# EasyEDA Pro project RCKid3.eprj, board RCKid (continued)
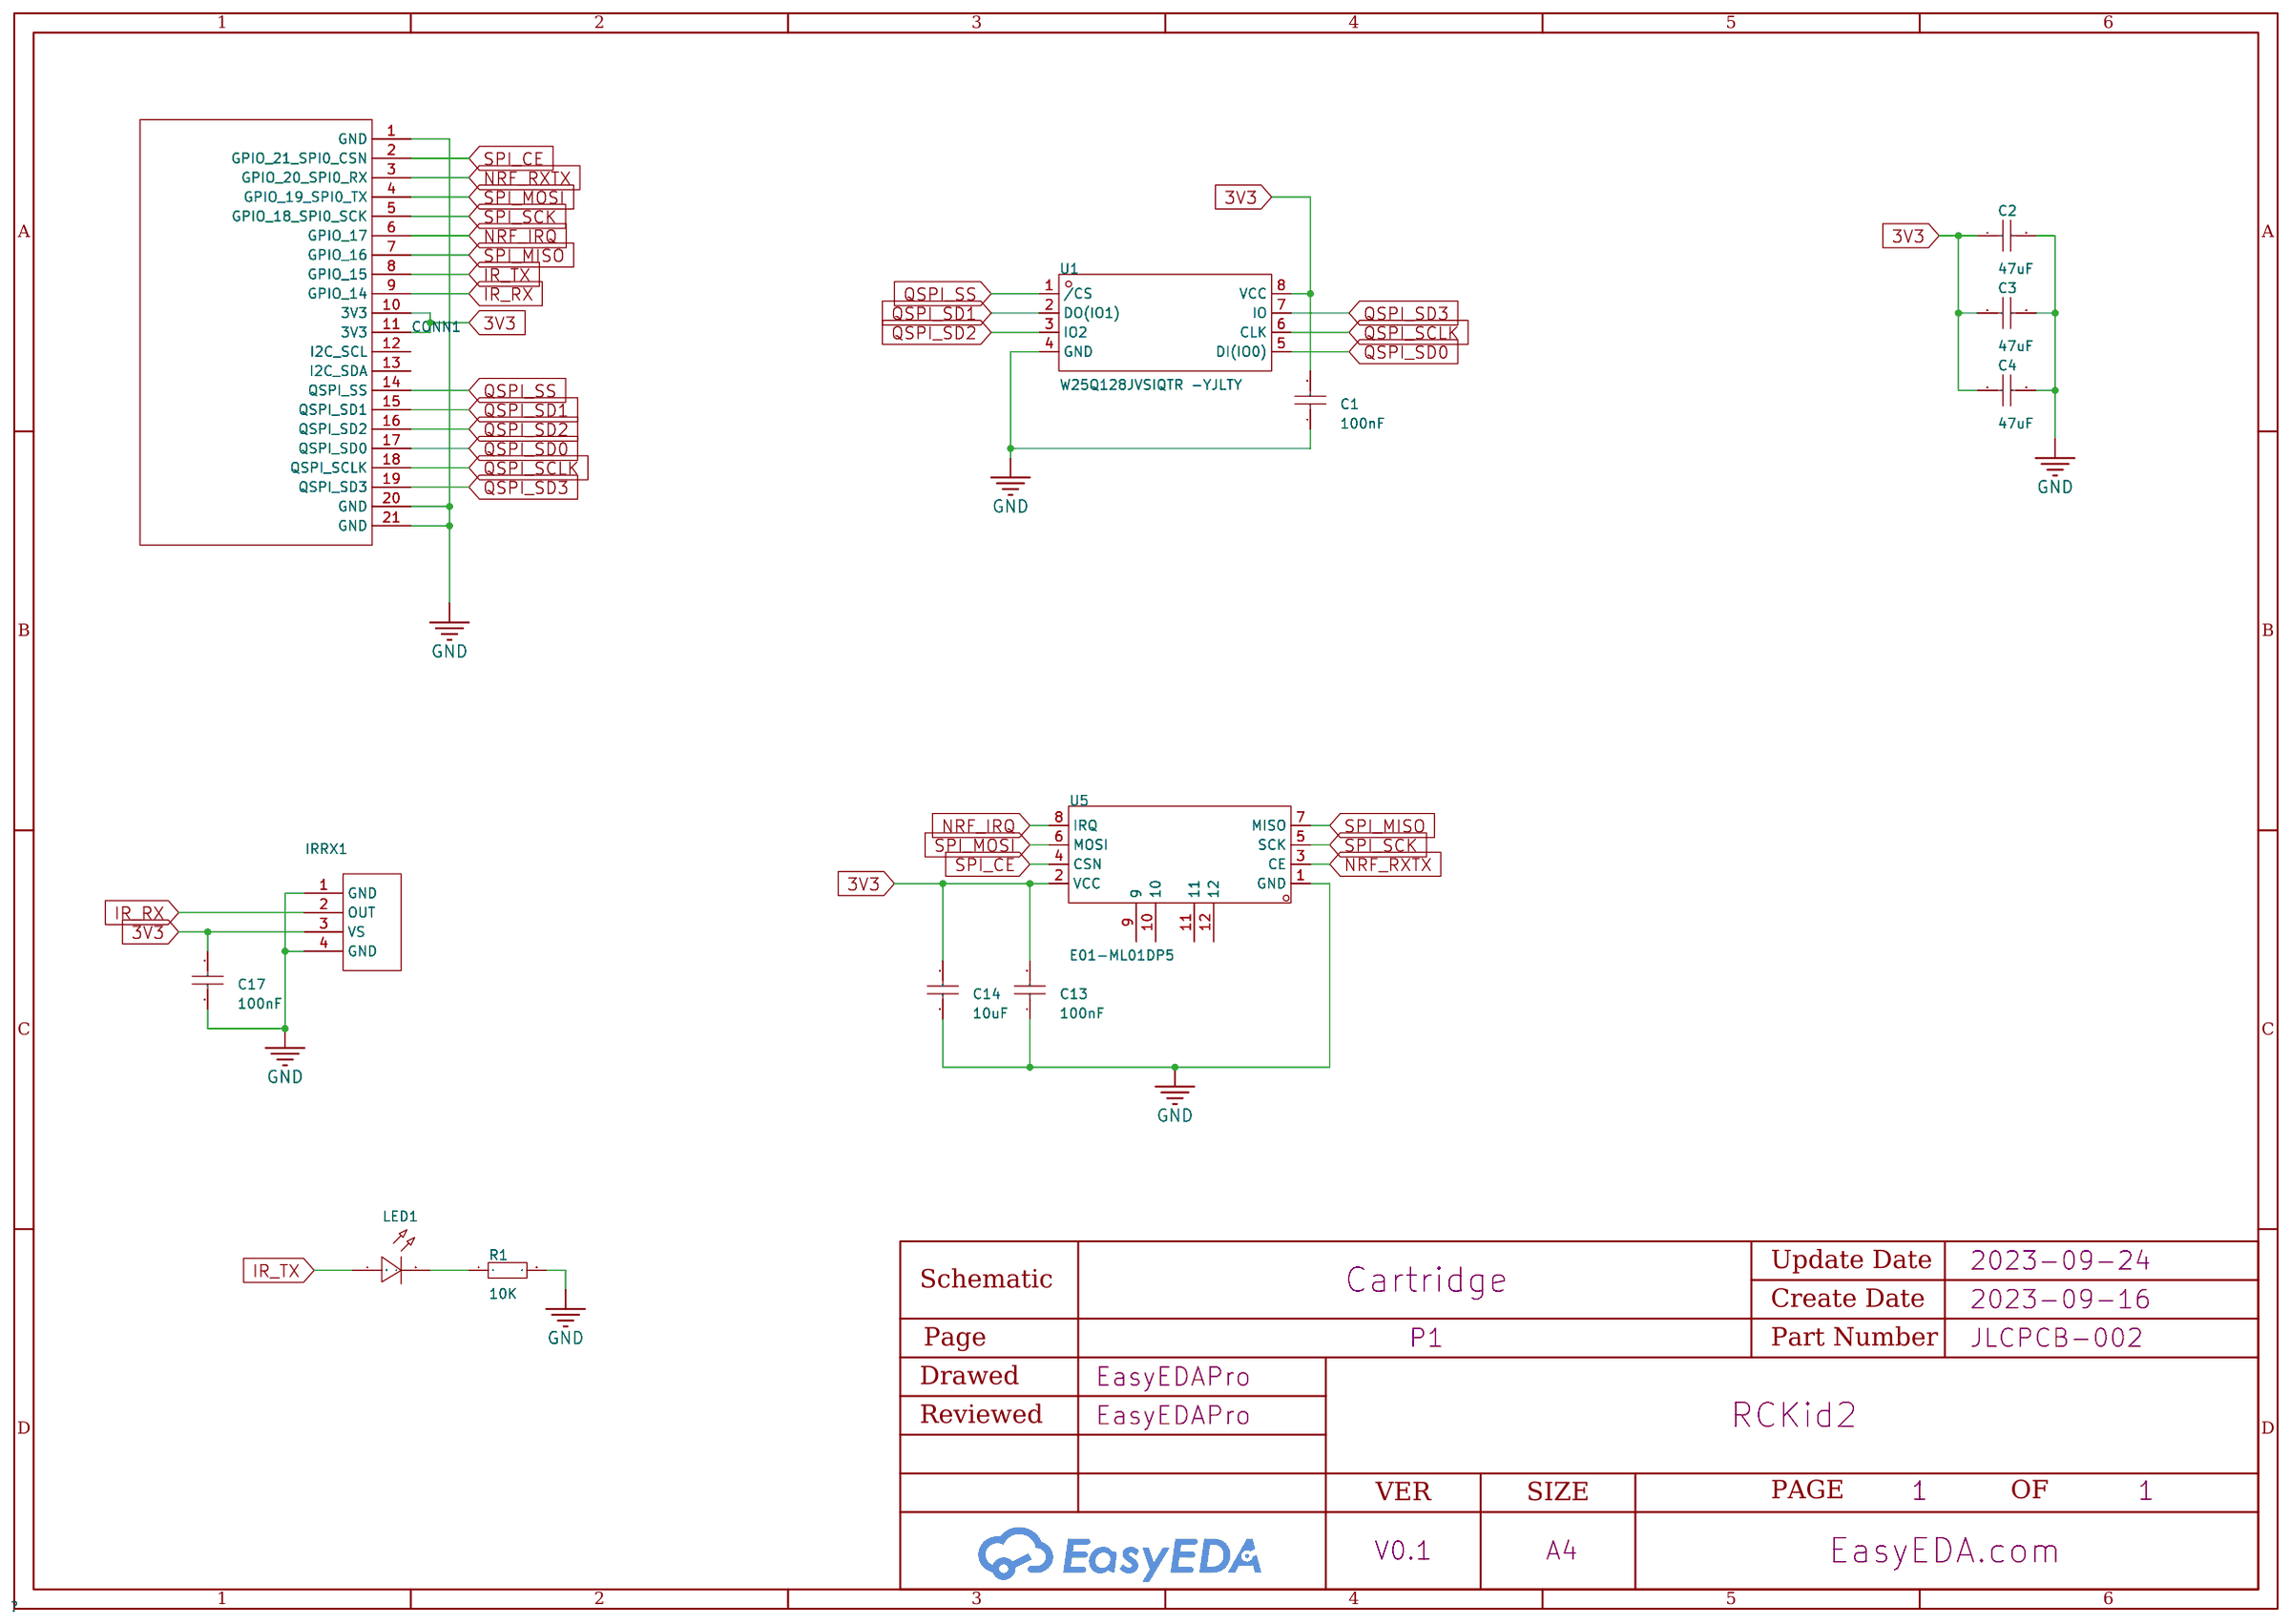
[diagram p0: NRF24L01P]
## Routing (per net, layer and track width the routed paths; a pad name or vN(x,y) marks a point on that pad's centre or on a via; arc(x,y) is an arc through that point) (continued)
MIC_N: length 6.7
  Top Layer w0.15: AUDIO.13 55.05,34.24 53.9,33.09 C206.1
MIC_P: length 4.5
  Top Layer w0.15: 55.7,30.44 55.9,30.44 55.9,33.19 56.45,33.74 AUDIO.14
PWM_BACKLIGHT: length 37.9
  Top Layer w0.15: v1(31.9,51.79) 32.25,51.44 32.25,50.22
  Top Layer w0.2: v1(45.5,69.89) 52.3,69.89 53.4,70.99 R92.2
  Bottom Layer w0.15: v1(45.5,69.89) 40.4,64.79 40.4,60.09 39.8,59.49 34.5,59.49 31.9,56.89 v1(31.9,51.79)
PWM_RUMBLER: length 3.8
  Top Layer w0.15: AVR.2 32.25,43.87 33.3,42.82
PWR_INT: length 48.1
  Top Layer w0.15: 31.7,43.49 29.2,43.49 28.1,42.39 26.8,42.39 v1(26.4,41.99) ; v1(19.7,23.69) v1(18.3,25.09) ; v1(12.7,19.69) 12.7,20.29 12.61,20.29 PWR.7 ; 32.2,42.89 32.2,42.99 31.75,43.44 AVR.1
  Bottom Layer w0.15: v1(19.7,23.69) 20.7,22.69 20.7,18.69 R127.2 R126.1 ; v1(26.4,41.99) 26.4,33.19 v1(18.3,25.09) 13.9,20.69 13.9,20.09 13.5,19.69 v1(12.7,19.69)
QSPI_SCLK: length 16.3
  Top Layer w0.15: CARTRIDGE.19 13.8,61.01 13.8,61.89 arc(13.89,62.1) 14.1,62.19 14.3,62.19 arc(14.6,62.49) 14.3,62.79 14.1,62.79 arc(13.8,63.09) 14.1,63.39 14.3,63.39 arc(14.6,63.69) 14.3,63.99 14.1,63.99 arc(13.89,64.08) 13.8,64.29 13.8,64.79 15.4,66.39 15.4,70.09 14.4,71.09 RP2350B.71
QSPI_SD0: length 16.3
  Top Layer w0.15: CARTRIDGE.18 16.32,61.89 arc(16.41,62.1) 16.62,62.19 16.7,62.19 arc(17,62.49) 16.7,62.79 16.62,62.79 arc(16.32,63.09) 16.62,63.39 16.7,63.39 arc(17,63.69) 16.7,63.99 16.62,63.99 arc(16.32,64.29) 16.62,64.59 16.7,64.59 arc(17,64.89) 16.7,65.19 16.62,65.19 arc(16.41,65.28) 16.32,65.49 16.32,69.87 14.8,71.39 RP2350B.72
QSPI_SD1: length 16.4
  Top Layer w0.15: CARTRIDGE.16 21.4,61.89 arc(21.49,62.1) 21.7,62.19 21.8,62.19 arc(22.1,62.49) 21.8,62.79 21.7,62.79 arc(21.49,62.88) 21.4,63.09 21.4,66.19 15.6,71.99 RP2350B.74
QSPI_SD2: length 16.5
  Top Layer w0.15: RP2350B.73 15.2,71.69 18.86,68.03 18.86,64.29 arc(18.95,64.08) 19.16,63.99 19.3,63.99 arc(19.6,63.69) 19.3,63.39 19.16,63.39 arc(18.86,63.09) 19.16,62.79 19.3,62.79 arc(19.6,62.49) 19.3,62.19 19.16,62.19 arc(18.95,62.1) 18.86,61.89 CARTRIDGE.17
QSPI_SD3: length 16.3
  Top Layer w0.15: RP2350B.70 14,70.79 14.9,69.89 14.9,66.99 11.2,63.29 11.2,62.99 arc(11.29,62.78) 11.5,62.69 11.8,62.69 arc(12.1,62.39) 11.8,62.09 11.5,62.09 arc(11.29,62) 11.2,61.79 11.2,61.03 CARTRIDGE.20
QSPI_SS: length 33.9
  Top Layer w0.15: v1(27.5,54.69) 27.5,51.99 28.3,51.19 31.4,51.19 31.75,50.84 31.75,50.22 ; 24,59.32 23.94,59.38 CARTRIDGE.15 23.94,64.35 16,72.29 RP2350B.75
  Bottom Layer w0.15: CARTRIDGE.15 27.5,57.43 v1(27.5,54.69)
RADIO_INT: length 82.1
  Top Layer w0.15: RADIO.18 54.74,18.35 v1(54.2,18.89) ; v1(52.3,28.59) 52.3,39.69 50.3,41.69 50.3,53.19 47.4,56.09 34.4,56.09 34,56.49 31.2,56.49 28,59.69 28,63.49 22.5,68.99 22.5,71.49 19.11,74.88 RP2350B.1
  Bottom Layer w0.15: v1(52.3,28.59) 52.3,22.09 TP4.1 54.2,19.89 v1(54.2,18.89)
RADIO_L: length 3.4
  Top Layer w0.15: AUDIO.15 56.75,33.24 56.5,32.99 56.5,31.49 56.7,31.29 56.7,30.44
RADIO_R: length 2.5
  Top Layer w0.15: AUDIO.16 57.17,31.62 57.7,31.09 57.7,30.44
RADIO_RESET: length 90.4
  Top Layer w0.15: v1(52.2,20.79) 52.2,16.49 v1(53.6,15.09) ; v1(58.3,15.59) 58.02,15.87 RADIO.5 ; RP2350B.79 17.6,73.44 17.75,73.29 18.7,73.29 21.6,70.39 21.6,69.04 27.6,63.04 27.6,59.19 30.9,55.89 33.7,55.89 34.1,55.49 47.1,55.49 49.7,52.89 49.7,41.39 51.7,39.39 v1(51.7,29.49)
  Bottom Layer w0.15: v1(58.3,15.59) 58.3,15.19 57.8,14.69 54,14.69 v1(53.6,15.09) ; v1(52.2,20.79) 51.7,21.29 v1(51.7,29.49)
RGB: length 5.1
  Top Layer w0.15: U33.3 37.45,44.44 36.3,45.59 36.3,46.59 35.95,46.94 35.02,46.94
RPI_SWCLK: length 26.7
  Top Layer w0.15: RP2350B.33 13.2,85.49 v1(12.7,85.99)
  Bottom Layer w0.15: 1.4,71.3 3,72.9 3,84.89 4.1,85.99 v1(12.7,85.99)
RPI_SWD: length 25.4
  Top Layer w0.15: RP2350B.34 12.8,84.89 12,85.69 v1(12,86.89)
  Bottom Layer w0.15: v1(12,86.89) 4.1,86.89 1.4,84.19 1.4,73.84
SD_CSN: length 80.6
  Top Layer w0.15: RP2350B.56 8.4,76.79 7.5,75.89 2.6,75.89 1,77.49 1,89.79 1.2,89.99 1.2,96.59 5.6,100.99 34.3,100.99 34.6,100.69 46.7,100.69 48,99.39 L15.2
SD_RX: length 78.2
  Top Layer w0.15: L15.3 47.6,98.89 46.5,99.99 34.4,99.99 33.8,100.59 6,100.59 1.8,96.39 1.8,89.79 1.4,89.39 1.4,77.79 2.9,76.29 7.3,76.29 8.2,77.19 RP2350B.55
SD_SCK: length 73.4
  Top Layer w0.15: RP2350B.53 7.87,77.99 6.97,77.09 3.5,77.09 2.2,78.39 2.2,88.59 3,89.39 3,95.99 6.8,99.79 32.8,99.79 34,98.59 46.1,98.59 46.8,97.89 L15.5
SD_TX: length 75.8
  Top Layer w0.15: RP2350B.54 8.03,77.59 7.13,76.69 3.2,76.69 1.8,78.09 1.8,88.99 2.4,89.59 2.4,96.19 6.4,100.19 33.3,100.19 34.2,99.29 46.3,99.29 47.2,98.39 L15.4
SDIO_1: length 71
  Top Layer w0.15: L15.6 46.4,97.39 45.9,97.89 33.8,97.89 32.3,99.39 7.2,99.39 3.6,95.79 3.6,89.19 2.6,88.19 2.6,78.69 3.8,77.49 6.8,77.49 7.7,78.39 RP2350B.52
SDIO_2: length 83
  Top Layer w0.15: RP2350B.57 8.57,76.39 7.67,75.49 2.3,75.49 0.6,77.19 0.6,96.79 5.2,101.39 46.9,101.39 48.4,99.89 L15.1
SPEAKER_EN: length 12.2
  Top Layer w0.15: v1(62.1,37.09) 62.03,37.02 AUDIO.32 ; 63.7,27.19 v1(64.3,27.79)
  Bottom Layer w0.15: v1(62.1,37.09) 62.5,37.09 64,35.59 64,28.69 64.3,28.39 v1(64.3,27.79)
SPEAKER_N: length 2.9
  Top Layer w0.15: AUDIO.22 60.35,31.34 60.7,30.99 61.3,30.99 61.7,30.59 R105.1
SPEAKER_P: length 3.3
  Top Layer w0.15: R106.1 62.7,30.49 61.8,31.39 61,31.39 60.85,31.54 AUDIO.23
SPI0_CSN_GPIO_21:
  vias: v1(-25.5,74.59)
SPI0_RX_GPIO_20:
  vias: v1(-23,74.59)
SPI0_SCK_GPIO_18:
  vias: v1(-17.9,74.59)
SPI0_TX_GPIO_19:
  vias: v1(-20.4,74.59)
UPDI: length 37.4
  Top Layer w0.15: 30.92,47.49 AVR.23 24.85,47.44 14.1,58.19 v1(12.8,58.19)
  Bottom Layer w0.15: DEBUG.2 1.44,66.25 9.5,58.19 v1(12.8,58.19)
USB_DM: length 72.6
  Top Layer w0.15: USB.A7 12.95,10.24 13.1,10.39 v1(13.1,10.79)
  Top Layer w0.154: USB.B7 11.95,10.64 12.1,10.79 v1(12.1,11.29) 12.1,11.66 11.47,12.29 6.87,12.29 0.89,18.26 0.89,46.62 9.99,55.72 9.99,63.92 12.3,66.22 12.3,66.59 12,66.89 R50.1
  Bottom Layer w0.15: v1(12.1,11.29) 12.6,11.29 v1(13.1,10.79)
USB_DP: length 72.9
  Top Layer w0.154: 12.9,11.29 13.3,11.29 13.6,10.99 13.6,10.59 13.4,10.39 13.4,9.61 USB.B6 ; 12.9,11.29 11.59,12.6 6.99,12.6 1.2,18.39 1.2,46.49 10.3,55.59 10.3,63.79 13.2,66.69 R51.1 ; 12.9,11.29 12.45,10.84 USB.A6
VUSB: length 16.5
  Top Layer w0.25: PWR.1 9.45,17.89 9.35,17.79
  Top Layer w0.5: v1(10.6,11.49) 10.3,11.19 USB.B9A4 ; USB.A9B4 v1(15.1,10.59) v1(15.1,11.19)
  Bottom Layer w0.5: v1(15.1,10.59) v1(15.1,11.19) v1(14.6,11.69) v1(14.1,12.19) v1(13,12.19) 11.3,12.19 v1(10.6,11.49) ; v1(12.5,15.19) D16.2 12.47,14.29 v1(11.6,14.29) R52.2
  Bottom Layer w0.7: D16.2 13.43,14.32 13.65,14.54 Q8.1
  vias: v1(13.4,14.29)
XIN: length 10.3
  Top Layer w0.2: RP2350B.30 14.4,86.67 14.6,86.87 14.6,88.74 C153.1 14.5,90.35 14.5,91.99 15.35,92.84 U39.1
XOUT: length 3.4
  Top Layer w0.2: RP2350B.31 14,87.26
$1N1000: length 4.5
  Top Layer w0.5: 5V.4 31.1,25.69 29,25.69 28.3,24.99 C83.1
$1N1001: length 4.5
  Top Layer w0.5: C83.2 28.3,22.99 29,22.29 31.1,22.29 5V.6
$1N63321: length 0.5
  Top Layer w0.15: PWR.2 PWR.3
$1N63464: length 6.5
  Top Layer w0.25: PWR.22 8.78,21.29 4.45,21.29 3.64,20.49 3.53,20.38 3.53,19.49
$1N63621: length 4.3
  Top Layer w0.15: 14.5,18.49 13.9,18.49 13.6,18.79 13.6,20.99 13.3,21.29 PWR.9
$1N63731: length 3.5
  Top Layer w0.25: C215.2 6.95,20.54 7.55,20.54 7.8,20.79 8.78,20.79 PWR.23
  Top Layer w0.5: C215.2 6.8,19.09
$1N64929: length 5.2
  Top Layer w0.25: 3.6,21.95 3.75,21.79 PWR.21
$1N65109: length 5.6
  Top Layer w0.15: PWR.8 13.1,20.79 13.2,20.69 13.2,17.29 13.6,16.89 14.33,16.89 14.5,16.72
$1N65541: length 13.5
  Top Layer w0.15: R113.1 2.63,18.59 v1(4.4,18.59) ; 12.6,22.29 v1(13.6,22.29)
  Bottom Layer w0.15: v1(13.6,22.29) 12.8,21.49 7.4,21.49 4.5,18.59 v1(4.4,18.59)
$1N65681: length 2
  Top Layer w0.15: PWR.10 13.4,21.79 13.6,21.59 14.35,21.59 14.5,21.74 14.5,21.74
$1N67269: length 1.9
  Top Layer w0.27: 27.2,32.59 27.2,33.79 26.7,34.29
$1N67295: length 4.2
  Top Layer w0.15: 27.9,29.59 26.8,29.59 ; 27.9,28.49 27.9,29.49 28,29.59 28,30.29 27.7,30.59 27.7,31.39
$1N67403: length 4.3
  Top Layer w0.15: 38,36.39 38,35.29 ; 38,36.39 38,37.19 37.7,37.49 37.7,38.29 ; 38,36.39 36.8,36.39
$1N67445: length 1.7
  Top Layer w0.27: 37.2,39.39 37.2,40.49 36.8,40.89
$1N73932: length 22.3
  Bottom Layer w0.7: Q8.2 13.55,16.44 13.33,16.66 D16.1 9.27,16.66 8.7,16.09 5.5,16.09 3.5,18.09 3.5,27.96 AAA_PWR.1
$1N75550: length 2.5
  Top Layer w0.15: v1(13.3,22.89) 13.2,22.79 12.6,22.79
  Bottom Layer w0.15: v1(13.3,22.89) 14,22.89 14.7,23.59 TP1.1
$2N19576: length 11.7
  Top Layer w0.15: v1(48,93.19) 47.6,93.59 L15.14 ; R76.2 50.53,87.69 50.9,87.69 v1(51.4,88.19) 51.9,87.69 microSD.7
  Bottom Layer w0.15: v1(51.4,88.19) 51.4,89.79 v1(48,93.19)
$2N25545: length 5.2
  Top Layer w0.15: L15.16 48.4,94.99 49.1,94.29 microSD.1
$2N25554: length 6.6
  Top Layer w0.15: microSD.2 49.1,93.19 48.95,93.19 48,94.14 L15.15
$2N25581: length 8.4
  Top Layer w0.15: microSD.3 48.3,92.09 47.2,93.19 L15.13
$2N25588: length 11
  Top Layer w0.15: microSD.5 47.8,89.89 46.8,90.89 L15.12
$2N25598: length 14
  Top Layer w0.15: microSD.8 48.6,86.59 46.4,88.79 L15.11
$2N27404: length 2.2
  Top Layer w0.15: R120.1 23.2,53.99 23.75,53.44 U40.7
$2N27409: length 2
  Top Layer w0.15: U40.9 24.56,51.23 24.8,50.99 24.8,50.62 R119.1
$3N64809: length 1.8
  Top Layer w0.15: AUDIO.18 58.35,31.14 58.7,30.79 58.7,30.44
$3N64814: length 2.6
  Top Layer w0.15: AUDIO.24 61.93,32.06 62.6,31.39 63.66,31.39 63.7,31.44
$3N64820: length 2.4
  Top Layer w0.25: 64.1,35.55 64.1,35.49 63.35,34.74 AUDIO.29
$3N65040: length 3
  Top Layer w0.15: v1(61.6,37.89) 61.35,37.64 AUDIO.1
  Bottom Layer w0.15: TP3.1 61.1,37.39 v1(61.6,37.89)
$3N65354: length 12.8
  Top Layer w0.15: v1(55.9,28.29) 55.9,29.05 55.79,29.16 54.9,29.16 ; v1(53.1,27.39) 45.3,27.39
  Bottom Layer w0.15: v1(55.9,28.29) 55,27.39 v1(53.1,27.39)
$3N65358: length 11.9
  Top Layer w0.15: 53.9,29.05 53.9,27.14 ; 53.9,27.14 53.9,27.11 53.48,26.69 45.3,26.69 ; 53.9,27.14 54.35,26.69 54.77,26.69 R104.2
$3N65820: length 3.5
  Top Layer w0.15: 61.7,29.19 61.7,26.39 62.2,25.89
$3N66044: length 2.9
  Top Layer w0.25: 58.2,7.49 C200.1
$3N66054: length 3.1
  Top Layer w0.25: HEADSET.4 49.51,11.19 47.09,11.19 C199.1
$3N66059: length 10.7
  Top Layer w0.25: 58.2,4.79 58.49,5.09 L18.1 60.9,5.19 61.8,6.09 62.3,6.09 62.7,6.49 62.7,9.19 62.14,9.75 C242.1
$3N66555: length 3.1
  Top Layer w0.15: 62.7,29.19 62.7,27.99 62.5,27.79 62.5,26.59 62.8,26.29
$3N66592: length 8.5
  Top Layer w0.25: 65.8,24.99 66.2,24.59 67.1,24.59 67.7,23.99 67.7,22.59 SPEAKER.1
$3N66597: length 3.5
  Top Layer w0.25: 62.5,20.99 62.5,21.09 64,22.59 64,23.29 64.4,23.69
$3N73775: length 7.7
  Top Layer w0.25: 58.55,23.79 58.9,23.45 C238.1 59.8,22.89 60.1,22.59 60.1,18.99 59.46,18.35 RADIO.9
$3N73781: length 6.4
  Top Layer w0.25: 56.05,23.79 56,23.74 56,21.69 55.45,21.15 C239.2 55,19.09 55.24,18.85 RADIO.17
$3N73999: length 10.2
  Top Layer w0.15: 57.87,28.98 57.8,29.05 57.7,29.05 ; 57.87,28.98 57.87,26.09 57.77,25.99 57.77,25.76 v1(57.7,25.69) ; 57.87,28.98 57.87,29.01 57.9,29.05 ; 57.52,19.5 57.52,20.11 v1(57.7,20.29)
  Bottom Layer w0.15: v1(57.7,20.29) 58.09,20.68 58.09,25.3 v1(57.7,25.69)
$3N74004: length 10.3
  Top Layer w0.15: 56.9,28.95 56.9,29.05 ; 56.9,28.95 56.8,29.05 56.7,29.05 ; 56.9,28.95 56.9,26.06 56.83,25.99 56.83,25.72 v1(56.8,25.69) ; 57.02,19.5 57.02,20.07 v1(56.8,20.29)
  Bottom Layer w0.15: v1(56.8,25.69) 56.37,25.26 56.37,20.72 v1(56.8,20.29)
$3N78093: length 7.2
  Top Layer w0.15: RADIO.19 53.56,17.85 v1(52.9,17.19)
  Bottom Layer w0.15: TP5.1 50.8,17.19 v1(52.9,17.19)
$4N10766: length 24.8
  Top Layer w0.15: v1(29.1,20.49) 29.83,20.49 29.9,20.56 ; RIGHT1.1 16.8,31.59 19.55,31.59 23.45,27.69 v1(23.5,27.69)
  Top Layer w0.2: RIGHT1.3 RIGHT1.1
  Bottom Layer w0.15: v1(23.5,27.69) 25.7,25.49 25.7,23.89 v1(29.1,20.49)
$4N10774: length 41.7
  Top Layer w0.15: v1(30.84,20.45) 31.44,20.45 31.5,20.39 ; 24.3,27.69 19.3,32.69 11.5,32.69 5.7,38.49 TOP1.1
  Top Layer w0.2: TOP1.3 TOP1.1
  Bottom Layer w0.15: v1(30.84,20.45) 26.3,24.99 26.3,25.69 v1(24.3,27.69)
$4N10782: length 45.2
  Top Layer w0.15: v1(24.3,28.49) 24.3,28.54 20.7,32.14 20.7,48.69 17.9,51.49 LEFT1.3 ; v1(32.5,20.49) 33.2,20.49 33.3,20.59
  Top Layer w0.2: LEFT1.3 LEFT1.1
  Bottom Layer w0.15: v1(24.3,28.49) 30,22.79 30.2,22.79 v1(32.5,20.49)
$4N10794: length 31.1
  Top Layer w0.15: v1(34.2,20.49) 34.9,20.49 ; v1(25.1,28.59) 21.99,31.7 21.99,36.78 BOTTOM1.3
  Top Layer w0.2: BOTTOM1.3 BOTTOM1.1
  Bottom Layer w0.15: v1(34.2,20.49) 31.3,23.39 30.3,23.39 v1(25.1,28.59)
$4N10842: length 32.6
  Top Layer w0.15: D15.1 v1(46.6,49.59)
  Bottom Layer w0.15: VOL_DOWN.1 64.6,31.29 64.6,35.89 57.6,42.89 57.6,45.29 53.3,49.59 v1(46.6,49.59)
$4N10903: length 17.3
  Top Layer w0.15: B1.1 v1(56.2,49.49) ; v1(60.2,49.49) B1.3 ; D9.1 v1(46.6,51.29)
  Bottom Layer w0.15: v1(60.2,49.49) v1(56.2,49.49) 54.4,51.29 v1(46.6,51.29)
$4N10915: length 15.1
  Top Layer w0.15: A1.1 45.1,38.49 v1(45.7,39.09) 46.3,38.49 A1.3 ; D10.1 v1(44.6,46.19)
  Bottom Layer w0.15: v1(44.6,46.19) 44.6,40.19 v1(45.7,39.09)
$4N17155: length 24
  Top Layer w0.15: v1(46.6,47.89) D14.1 ; v1(56.7,47.09) v1(54.9,47.09)
  Bottom Layer w0.15: v1(46.6,47.89) 53.8,47.89 54.6,47.09 v1(54.9,47.09) ; v1(56.7,47.09) 57.9,47.09 VOL_UP.1
$4N18597: length 11
  Top Layer w0.2: B3.1 B3.3 26.73,20.46 D12.1
$4N18613: length 15.7
  Top Layer w0.2: B2.3 B2.1 44.2,23.04 42.95,24.29 40.4,24.29 36.7,20.59 D11.1
$4N38253: length 1.7
  Top Layer w0.6: R84.2 Q6.3
$4N49584: length 19.7
  Top Layer w0.15: LED10.4 14.4,40.99 v1(14.4,33.89) 14.45,33.94 14.45,35.04
  Top Layer w0.2: v1(14.4,30.19) 18.35,26.24 LED11.1
  Bottom Layer w0.2: v1(14.4,30.19) v1(14.4,33.89)
$4N49861: length 28.8
  Top Layer w0.15: LED8.1 58.95,48.24 v1(56.3,45.59)
  Bottom Layer w0.15: v1(46.4,31.69) 46.4,41.49 49.7,44.79 55.5,44.79 v1(56.3,45.59)
$4N49881: length 10.6
  Top Layer w0.2: LED12.4 42.65,21.24 v1(42.9,21.49)
  Bottom Layer w0.2: v1(48,28.89) 48,26.59 v1(42.9,21.49)
$4N49891: length 23.6
  Top Layer w0.2: v1(22,24.39) 21.95,24.44 LED11.4 ; LED12.1 v1(40.3,18.99)
  Bottom Layer w0.2: v1(22,24.39) 28.6,17.79 39.1,17.79 v1(40.3,18.99)
$4N50022: length 2.8
  Top Layer w0.15: R87.1 41.3,44.39 U33.4
$4N50025: length 20.7
  Top Layer w0.15: v1(47.7,51.89) 47.5,51.69 47.5,45.39 46.5,44.39 R87.2 ; v1(56.9,53.79) 57.45,53.24 LED8.4
  Bottom Layer w0.15: v1(47.7,51.89) 48,52.19 54.2,52.19 55,52.99 56.1,52.99 v1(56.9,53.79)
$4N50031: length 1.7
  Top Layer w0.2: R88.1 11.32,41.94 LED10.1
$4N56569: length 5.4
  Top Layer w0.5: RUMBLER.1 32,34.49
$4N56605: length 11
  Top Layer w0.15: Q9.1 34.35,33.54 32.3,35.59 32.3,39.99 33.3,40.99 33.3,41.79 34.33,41.79 34.5,41.96
$4N56656: length 3.2
  Top Layer w0.3: Q6.1 54.68,72.84 54.7,72.86
$4N78796: length 24.7
  Top Layer w0.15: D17.1 v1(46.6,52.99)
  Bottom Layer w0.15: HOME1.2 64.5,63.49 54,52.99 v1(46.6,52.99)
$4N81859: length 4.9
  Top Layer w0.25: 34.25,50.22 34.27,50.19 34.9,50.19 35.35,50.64 X1.1 38.3,50.64 C232.2
$4N81864: length 6.9
  Top Layer w0.25: 33.75,50.22 33.75,51.14 35.75,53.14 X1.2 38.3,53.14 C233.2
$6N10559: length 13.3
  Top Layer w0.2: R57.1 v1(5,7.99) ; USB.B5 14.45,10.54 v1(14.3,10.69)
  Bottom Layer w0.2: v1(14.3,10.69) 13.5,9.89 9.3,9.89 8.7,10.49 6.9,10.49 5,8.59 v1(5,7.99)
$6N10563: length 11.5
  Top Layer w0.2: USB.A5 11.45,10.64 v1(11.4,10.69) ; 3.8,7.32 v1(3.8,7.99)
  Bottom Layer w0.2: v1(11.4,10.69) 10.3,10.69 9.7,11.29 6.3,11.29 3.8,8.79 v1(3.8,7.99)
$7N680: length 5.9
  Top Layer w0.154: RP2350B.67 12.8,68.72 13.2,68.32
$7N687: length 5.9
  Top Layer w0.154: RP2350B.66 12.4,68.79 12.1,68.49 12.1,68.42 12,68.32
$7N1009: length 3.2
  Top Layer w0.2: U39.3 13.64,90.9 C154.1 13.8,89.34 13.8,88.12

## Copper pours and planes (outline as drawn; the poured copper is in the pictures)
3V3 on Inner2: 28.7,34.99 30.7,34.99 31.7,35.99 31.7,40.99 32.2,41.49 32.2,42.49 33.2,43.49 35.2,43.49 37.2,45.49 37.2,46.49 36.7,46.99 30.2,46.99 29.2,47.99 29.2,51.99 28.7,52.49 22.7,52.49 22.2,51.99 22.2,51.49 25.7,47.99 25.7,43.99 28.7,40.99
5V on Inner2: 34.2,24.99 34.2,29.99 36.2,31.99 40.7,31.99 43.7,34.99 43.7,44.99 51.2,52.49 55.2,52.49 55.7,51.99 55.7,50.99 55.2,50.49 52.7,50.49 46.7,44.49 46.7,31.99 44.2,29.49 38.2,29.49 37.2,28.49 37.2,24.49 38.2,23.49 40.2,23.49 40.7,23.99 41.2,23.99 41.7,23.49 41.7,21.49 39.2,18.99 25.7,18.99 24.2,20.49 18.7,20.49 17.2,18.99 9.7,18.99 7.7,20.99 7.7,41.49 11.2,44.99 15.7,44.99 16.7,43.99 16.7,40.49 10.7,34.49 10.7,24.49 11.7,23.49 16.2,23.49 19.2,26.49 25.7,26.49 28.7,23.49 32.7,23.49
GND on Inner1: -10.1,121.69 76.1,121.69 76.1,-5.21 -10.1,-5.21
VBATT on Top Layer: 15.2,21.99 14.2,22.99 11.2,22.99 11.2,23.99 11.4,24.19 17,24.19 17.7,23.49 17.7,17.49 23.7,14.99 23.7,8.49 20.7,8.49 20.7,9.49 15.2,14.99
VCC on Inner2: 10.7,24.49 10.7,26.99 17.2,33.49 30.7,33.49 32.7,35.49 32.7,39.99 33.2,40.49 34.2,40.49 34.7,39.99 34.7,32.99 32.7,30.99 32.7,26.49 33.2,25.99 33.2,23.99 32.7,23.49 28.7,23.49 25.7,26.49 19.2,26.49 16.2,23.49 11.7,23.49
IOVDD on Inner2: 6.7,86.49 41.3,86.49 48.5,93.69 54.7,93.69 55.6,92.79 55.6,67.79 64.7,58.49 64.7,32.49 65.7,31.49 65.7,26.99 68.2,26.99 68.2,20.99 59.2,20.99 57.7,22.49 57.7,37.49 56.7,38.49 56.7,39.49 57.7,40.49 57.7,51.99 56.7,52.99 49.7,52.99 42.7,45.99 42.7,36.49 38.7,32.49 36.2,32.49 35.7,32.99 35.7,33.49 39.7,37.5 39.7,40.49 37.7,42.49 37.7,53.49 19.8,71.49 6.7,71.49
VUSB on Top Layer: 15.7,12.49 15.7,10.99 12.7,10.99 12.7,11.99 10.7,13.99 9.2,13.99 8.9,14.29 8.9,19.49 9.3,19.89 9.6,19.89 9.6,18.59

## Text on the board
Bottom Silkscreen Layer: GND | SWD | SWC | ATX | UPDI | DBG|PGM | 47 | SD3 | SCLK | SD0 | SD2 | SD1 | SS | 3V3 | 11 | 12 | 13 | 14 | 15 | 16 | 17 | 18 | 19 | QSPI | GPIO|UART|SPI | + | - | USE AT YOUR OWN RISK. DO NOT CHARGE / UNATTENDED. DO NOT SHORT-CIRCUIT. DO / NOT INSERT OR REMOVE CARTRIDGES WHEN / POWERED ON. DC rating: 5V/1.5A. Charging / max 500mA, system 300mA, cartridge / 500mA. Operating temp: 0-40C | RCKid mk III (v 3.0) / (C) zduka 2022-25 - 19/1/25 / https://rc-kid.github.io | Li-Po: 3.7V, max size 503759. Min discharge / current 1.3A. USE PROTECTED CELLS ONLY!!! / AAA: 3x AAA Ni-Mh or Alkaline. DO NOT / SOLDER CHARGER WHEN AAA BATTERIES / ARE USED. | DO NOT SHORTCIRCUIT THE BATTERY / WHEN SOLDERING CONTACTS !!
Top Silkscreen Layer: JLCJLCJLCJLC
